# EasyEDA Pro project 立创天空星STM32F407主板.eprj, board PCB1
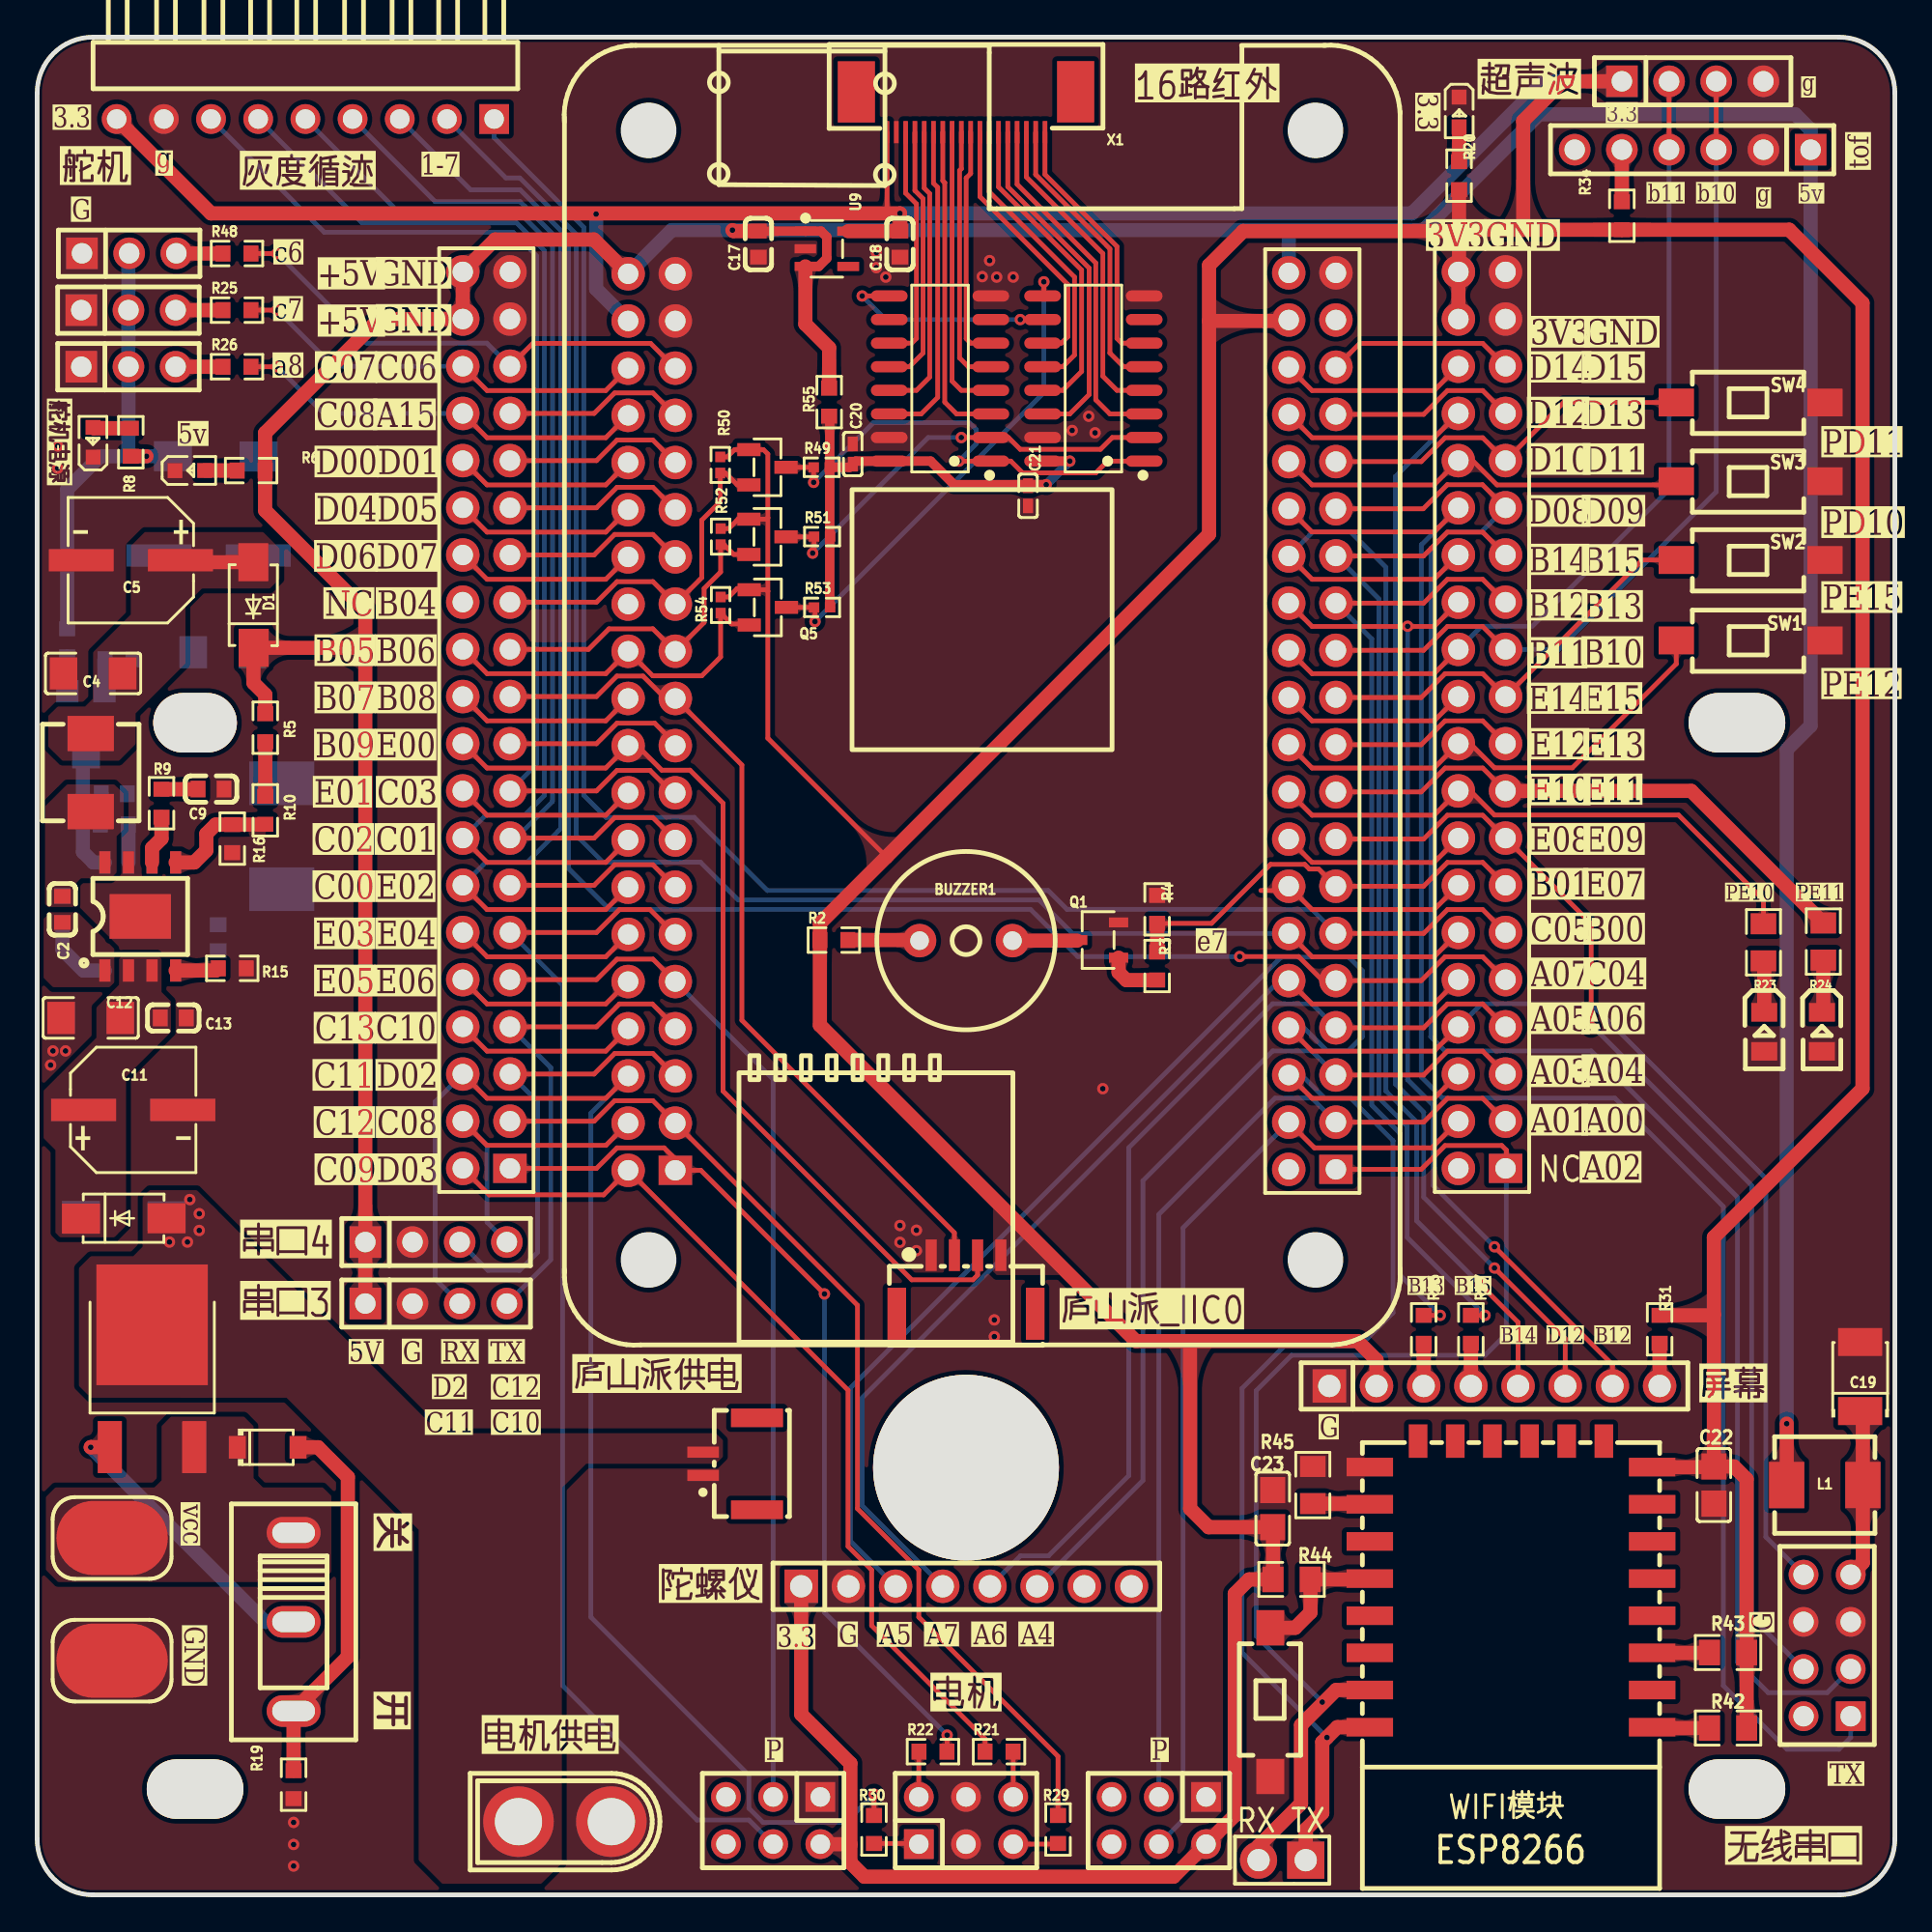
[diagram p4: board, top side]
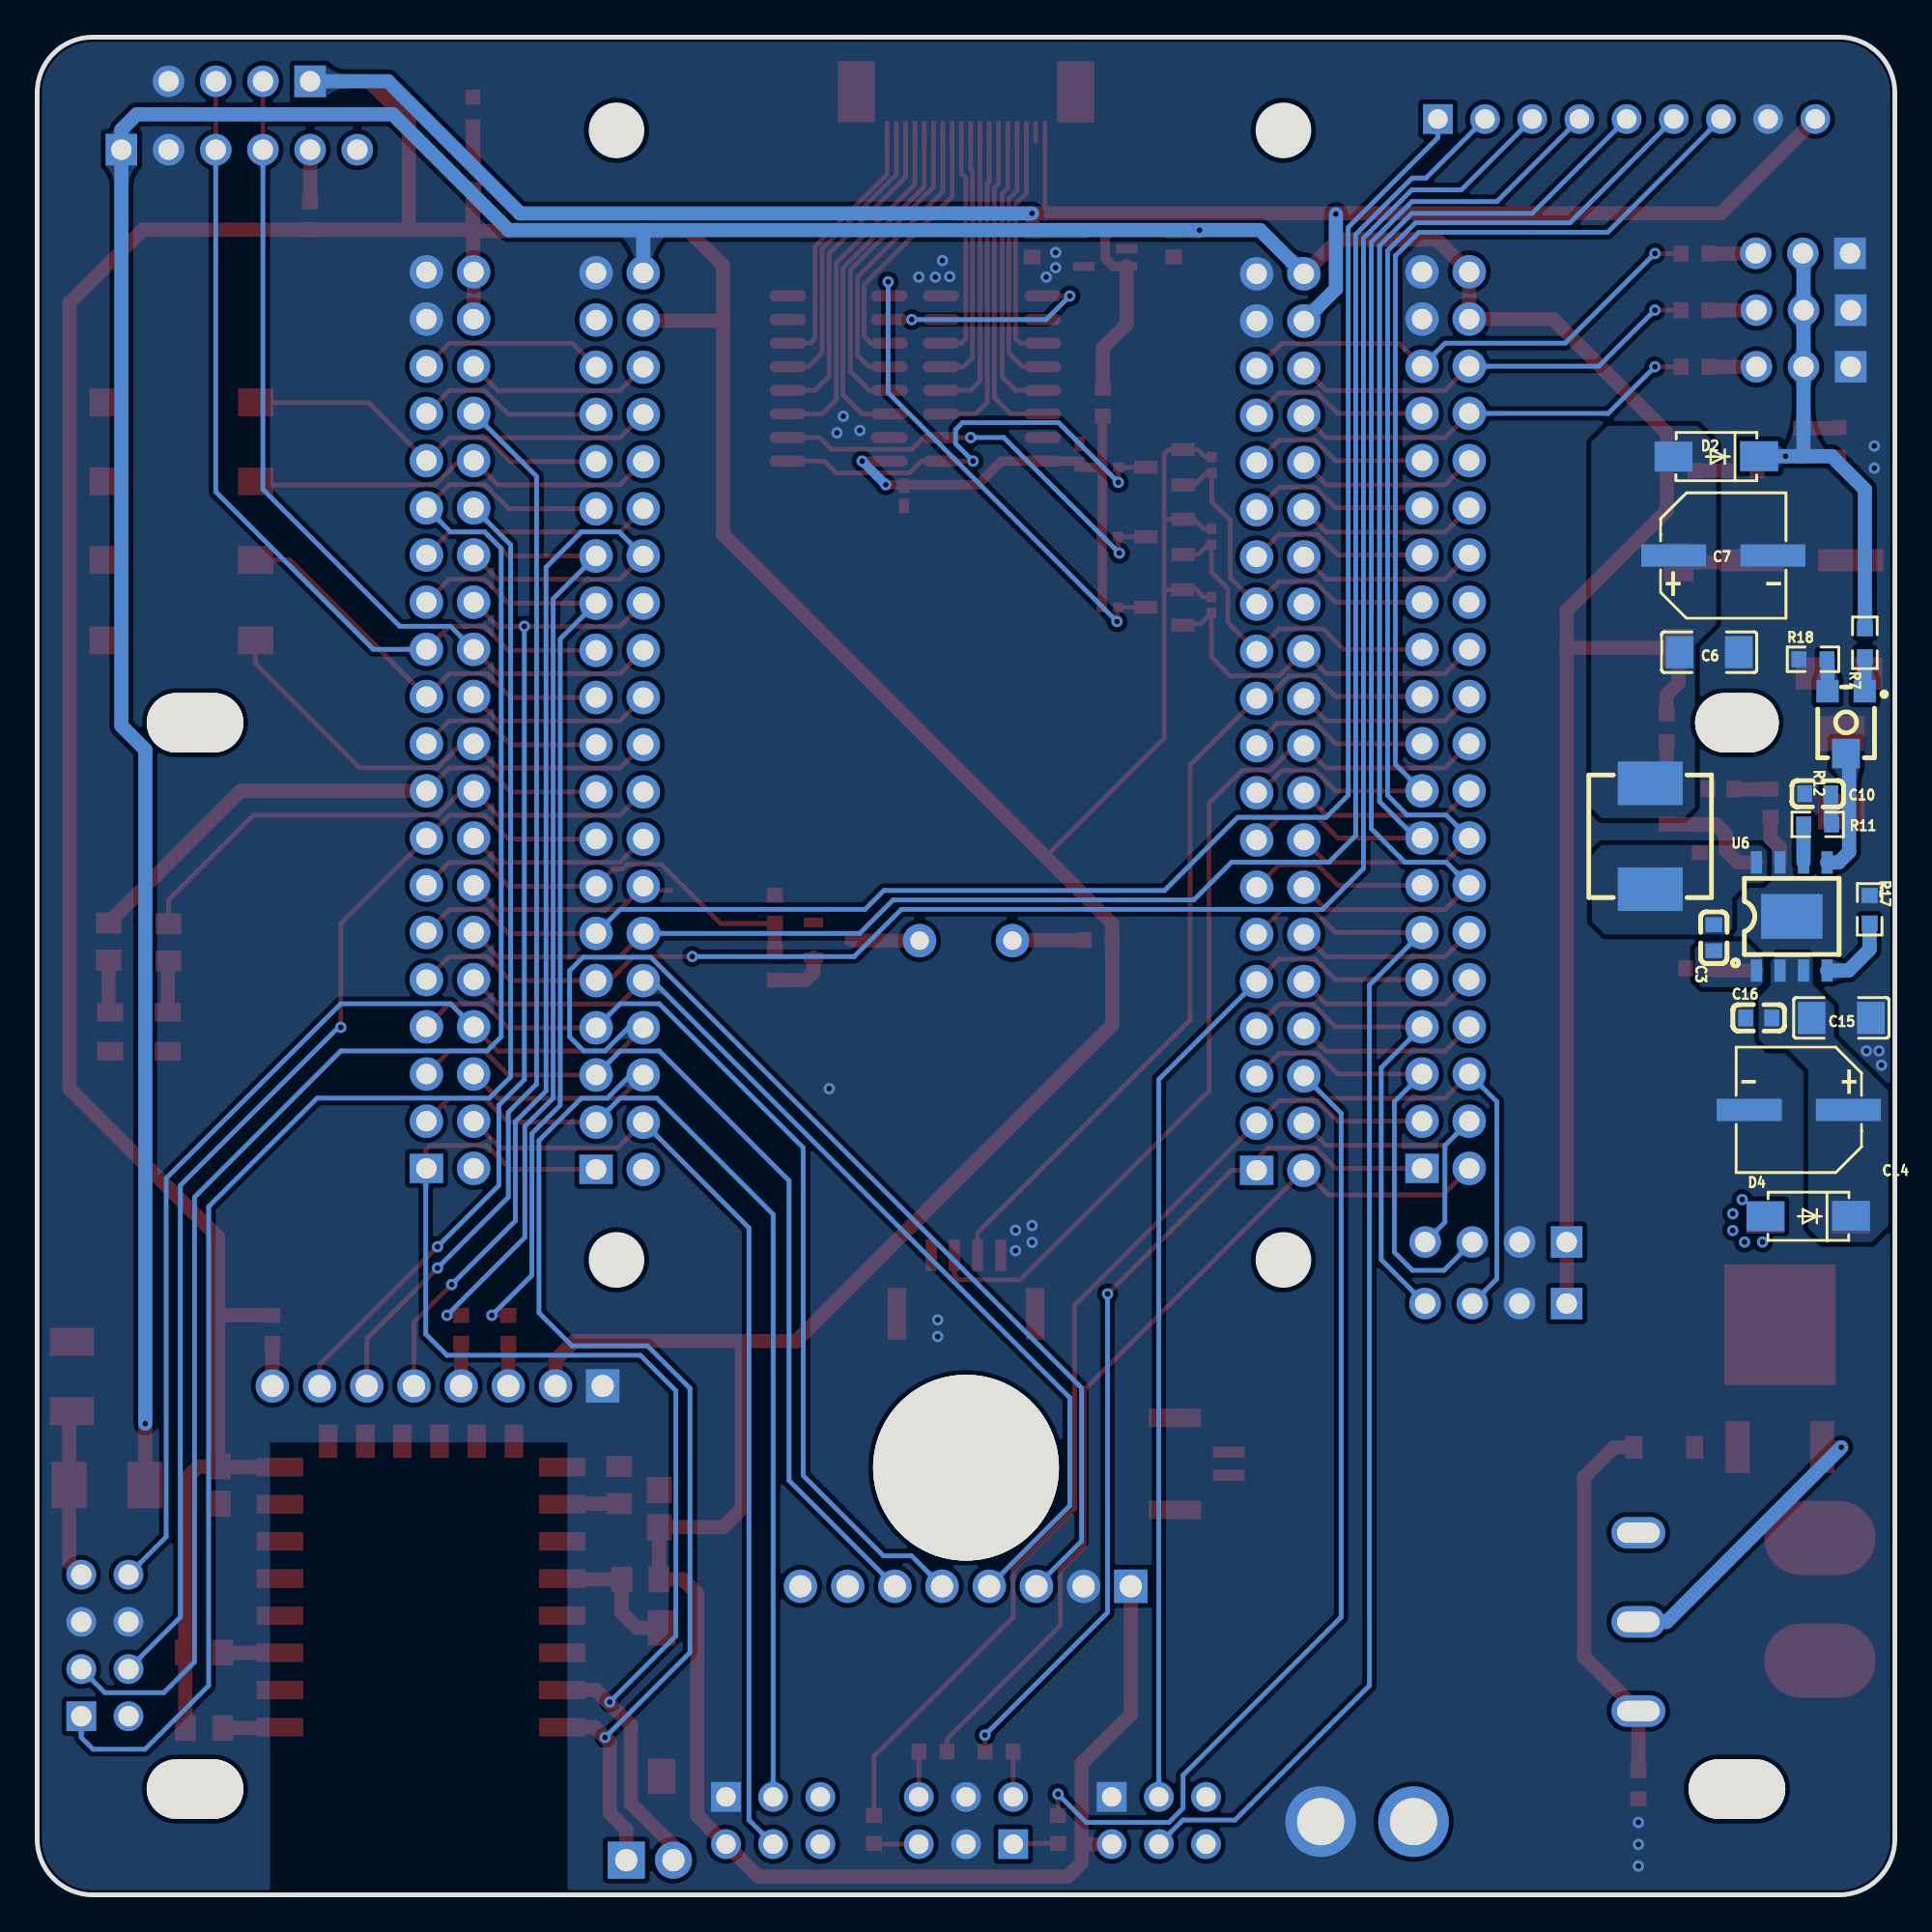
[diagram p5: board, bottom side, seen from below]

Outline 100 x 100 mm; copper layers: Top Layer, Bottom Layer. Coordinates in mm from the lower left corner of the outline.
Outline path: 0,97 arc(0.88,99.12) 3,100 97,100 arc(99.12,99.12) 100,97 100,3 arc(99.12,0.88) 97,0 3,0 arc(0.88,0.88) 0,3 0,97
Stack: Top Layer 0.035mm / Dielectric1 1.51mm FR4 er 4.5 / Bottom Layer 0.035mm

## Design rules (mm)
template: 自用
spacing copperThickness1oz (default): track to track 0.102, other pairs 0.152 to 0.3
spacing copperThickness2oz: track to track 0.203, other pairs 0.152 to 0.3
track width copperThickness1oz (default): min 0.127, default 0.254, max 2.54
track width copperThickness2oz: min 0.203, default 0.254, max 2.54
track width Power_high: min 1.524, default 1.524, max 3.81
track width Power_low: min 0.762, default 0.762, max 2.54
differential pair differentialPair (default): width min 0.127, default 0.254, max 2.54; gap min 0.152, default 0.152
via viaSize (default): diameter min 0.5, default 0.61, max 10; hole min 0.3, default 0.305, max 6.3

## Placement (name value [footprint] x y rotation side)
BUZZER1  3kHz  [BUZ-TH_BD9.6-P5.00-D0.7-FD]  50 51.37 0 top
C2  100nF  [C0603]  1.36 53.05 90 top
C3  100nF  [C0603]  9.74 51.52 90 bottom
C4  47uF  [C1206]  3.01 65.75 0 top
C5  100uF  [CAP-SMD_BD6.3-L6.6-W6.6-LS7.6-FD-1]  5.04 71.84 180 top
C6  47uF  [C1206]  9.99 66.89 0 bottom
C7  100uF  [CAP-SMD_BD6.3-L6.6-W6.6-LS7.6-FD-1]  9.23 72.1 180 bottom
C9  4.7nF  [C0603]  9.36 59.53 0 top
C10  4.7nF  [C0603]  4.15 59.27 0 bottom
C11  100uF  [CAP-SMD_BD6.3-L6.6-W6.6-LS7.6-FD-1]  5.17 42.25 0 top
C12  4.7uF  [C1206]  2.88 47.21 0 top
C13  100nF  [C0603]  7.33 47.21 180 top
C14  100uF  [CAP-SMD_BD6.3-L6.6-W6.6-LS7.6-FD-1]  5.17 42.25 0 bottom
C15  4.7uF  [C1206]  2.88 47.21 0 bottom
C16  100nF  [C0603]  7.33 47.21 180 bottom
C17  10uF  [C0603]  38.82 88.86 90 top
C18  10uF  [C0603]  46.44 88.86 90 top
C19  47uF  [CASE-B_3528]  98.13 27.9 90 top
C20  100nF  [C0402]  43.9 77.56 90 top
C21  100nF  [C0402]  53.34 75.31 270 top
C22  100nF  [C0805]  90.26 22.06 90 top
C23  100nF  [C0805]  66.51 20.79 270 top
CN1  XT30U-M  [CONN-TH_XT30U-M]  28.41 3.94 0 top
CN2  WAFER-GH1.25-2PWB  [CONN-TH_2P-P1.25_XUNPU_WAFER-GH1.25-2PWB]  37.3 23.2 90 top
D1  SS54  [SMA_L4.3-W2.6-LS5.0-FD]  11.65 69.43 270 top
D2  SS54  [SMA_L4.3-W2.6-LS5.0-FD]  9.61 77.43 180 bottom
D3  SS54  [SMA_L4.3-W2.6-LS5.0-FD]  4.66 36.41 180 top
D4  SS54  [SMA_L4.3-W2.6-LS5.0-FD]  4.66 36.54 180 bottom
D5  BZT52C16  [SOD-123_L2.7-W1.6-LS3.7-RD]  12.41 24.09 0 top
EVK2  LCKFB-LSPI-SkyStar-GD32F407VET6-LITE  [DIP-80_L44.97-W69.97-P2.54X2-LS35.9]  50.86 63.16 180 top
H3  -  [HDR-TH_3P-P2.54-V-M]  4.91 85.31 0 top
H4  -  [HDR-TH_3P-P2.54-V-M]  4.91 82.26 0 top
H5  PM254V-12-08-H85  [HDR-TH_8P-P2.54-V-F-R2-C4-S2.54]  96.35 13.42 90 top
H8  2.54-2*3  [HDR-TH_6P-P2.54-V-R2-C3-S2.54_A2541WV-2X3P]  50 4 0 top
H9  2.54-2*3  [HDR-TH_6P-P2.54-V-R2-C3-S2.54_A2541WV-2X3P]  39.62 4 180 top
H10  2.54-2*3  [HDR-TH_6P-P2.54-V-R2-C3-S2.54_A2541WV-2X3P]  60.38 4 180 top
H11  HC-PZ254-13.8L-1x9PWA  [HDR-TH_9P-P2.54-H-M-W10.4-N]  14.44 95.59 180 top
H12  -  [HDR-TH_4P-P2.54-V-F]  89.12 97.62 0 top
H13  PZ254V-11-06P  [HDR-TH_6P-P2.54-V-M]  89.12 93.94 180 top
H14  PZ254V-11-02P  [HDR-TH_2P-P2.54-V-M]  67.02 1.87 180 top
H15  -  [HDR-TH_3P-P2.54-V-M]  4.95 88.37 0 top
H16  KH-2.54PH180-1X4P-L11.5  [HDR-TH_4P-P2.54-V-M]  21.48 31.83 0 top
H17  KH-2.54PH180-1X4P-L11.5  [HDR-TH_4P-P2.54-V-M]  21.48 35.14 0 top
L1  4.7uH  [IND-SMD_L5.4-W5.2_FXL0530]  96.23 22.06 0 top
LED1  NCD0805R1  [LED0805-R-RD]  92.97 46.46 270 top
LED2  19-213/Y2C-CQ2R2L/3T(CY)  [LED0603-RD-YELLOW]  3.01 78.19 90 top
LED3  NCD0805R1  [LED0805-R-RD]  96.08 46.46 270 top
LED6  19-213/Y2C-CQ2R2L/3T(CY)  [LED0603-RD-YELLOW]  8.22 76.67 0 top
LED7  KT-0603R  [LED0603-RD]  76.54 95.97 270 top
NOREF  -  [Pad_e2595]  91.5 5.69 90 top
NOREF#2  -  [Pad_e2594]  91.5 63.09 90 top
NOREF#3  -  [Pad_e2593]  8.5 63.09 90 top
NOREF#4  -  [Pad_e2592]  50 22.99 0 top
NOREF#5  -  [Pad_e2596]  8.5 5.69 90 top
P1  2.54-1*8P母环保  [HDR-TH_8P-P2.54-V-F-1]  78.45 27.39 0 top
P2  2.54-1*8P母环保  [HDR-TH_8P-P2.54-V-F-1]  50.02 16.61 0 top
Q1  S8050 J3Y(RANGE:200-350)  [SOT-23-3_L3.0-W1.7-P0.95-LS2.9-BR]  57.11 51.4 0 top
Q2  HY19P03D  [TO-252-2_L6.6-W6.1-P4.57-LS9.9-TL-CW]  6.19 27.39 90 top
Q3  AO3400A  [SOT-23-3_L2.9-W1.3-P1.90-LS2.4-BR]  39.31 76.85 180 top
Q4  AO3400A  [SOT-23-3_L2.9-W1.3-P1.90-LS2.4-BR]  39.31 73.1 180 top
Q5  AO3400A  [SOT-23-3_L2.9-W1.3-P1.90-LS2.4-BR]  39.33 69.3 180 top
R2  10Ω  [R0603]  42.89 51.4 0 top
R3  4.7kΩ  [R0603]  60.29 50 270 top
R4  4.7kΩ  [R0603]  60.29 53.05 90 top
R5  51kΩ  [R0603]  12.28 62.83 90 top
R6  10k  [R0603]  11.52 76.67 0 top
R7  27k  [R0603]  1.61 67.4 90 bottom
R8  10k  [R0603]  5.04 78.19 270 top
R9  20kΩ  [R0603]  6.69 58.76 270 top
R10  1.5kΩ  [R0603]  12.28 58.38 90 top
R11  20kΩ  [R0603]  4.15 57.62 0 bottom
R12  50K  [RES-ADJ-SMD_3P-L3.8-W3.7_VGF39NCHXT]  2.62 63.11 90 bottom
R15  200kΩ  [R0603]  10.5 49.87 0 top
R16  10kΩ  [R0603]  10.5 56.86 90 top
R17  200kΩ  [R0603]  1.36 53.05 90 bottom
R18  8.2  [R0603]  4.41 66.51 180 bottom
R19  10kΩ  [R0603]  13.8 5.93 90 top
R20  4.7kΩ  [R0603]  76.54 92.55 270 top
R21  100Ω  [R0603]  51.78 7.71 0 top
R22  100Ω  [R0603]  48.22 7.71 0 top
R23  10K  [R0805]  92.93 51.28 90 top
R24  10K  [R0805]  96.15 51.32 90 top
R25  10K  [R0603]  10.76 85.31 0 top
R26  10K  [R0603]  10.76 82.26 0 top
R29  100Ω  [R0603]  54.95 3.52 270 top
R30  100Ω  [R0603]  45.05 3.52 90 top
R31  1KΩ  [R0603]  87.34 30.44 90 top
R34  10K  [R0603]  85.31 90.39 270 top
R42  10K  [R0805]  91.02 8.98 180 top
R43  10K  [R0805]  91.02 13.04 180 top
R44  10K  [R0805]  67.53 16.98 0 top
R45  10K  [R0805]  68.67 22.06 270 top
R46  100Ω  [R0603]  74.64 30.44 270 top
R47  100Ω  [R0603]  77.18 30.44 270 top
R48  10K  [R0603]  10.76 88.35 0 top
R49  10K  [R0402]  42.23 76.85 0 top
R50  4.7K  [R0402]  36.77 76.97 90 top
R51  10K  [R0402]  42.25 73.11 0 top
R52  4.7K  [R0402]  36.79 73.11 90 top
R53  10K  [R0402]  42.25 69.3 0 top
R54  4.7K  [R0402]  36.79 69.43 90 top
R55  10K  [R0603]  42.63 80.35 90 top
SW1  TS-1101-C-W  [SW-SMD_L6.0-W3.3-LS8.0]  92.24 67.53 0 top
SW2  TS-1101-C-W  [SW-SMD_L6.0-W3.3-LS8.0]  92.24 71.85 0 top
SW3  TS-1101-C-W  [SW-SMD_L6.0-W3.3-LS8.0]  92.24 76.09 0 top
SW4  TS-1101-C-W  [SW-SMD_L6.0-W3.3-LS8.0]  92.24 80.33 0 top
SW6  TS-1101-C-W  [SW-SMD_L6.0-W3.3-LS8.0]  66.38 10.38 270 top
SW7  SS12D10G6  [SW-TH_SHOU-HAN_SS12D10G4]  13.8 14.69 270 top
U1  GPHA201-2002A001A1BA  [HDR-TH_40P-P2.54-V-M-R2-C20-S2.54]  77.78 63.23 90 top
U2  GPHA201-2002A001A1BA  [HDR-TH_40P-P2.54-V-M-R2-C20-S2.54]  24.18 63.23 90 top
U3  4.7uH  [IND-SMD_L5.2-W5.2_MCW-0530]  2.88 60.41 90 top
U4  4.7uH  [IND-SMD_L7.2-W6.6_GPSR07X0]  13.17 56.98 90 bottom
U5  SCT2450STER  [ESOP-8_L4.9-W3.9-P1.27-LS6.0-BL-EP]  5.55 52.67 0 top
U6  SCT2450STER  [ESOP-8_L4.9-W3.9-P1.27-LS6.0-BL-EP]  5.55 52.67 180 bottom
U7  -  [WIREPAD-4X6]  4.03 19.21 0 top
U8  -  [WIREPAD-4X6]  4.03 12.61 0 top
U9  RT9013-33GB  [SOT-23-5_L3.0-W1.7-P0.95-LS2.8-BL]  42.51 88.61 270 top
U10  SN74LS165ADR  [SOIC-16_L9.9-W3.9-P1.27-LS6.0-BL]  56.86 81.62 90 top
U11  SN74LS165ADR  [SOIC-16_L9.9-W3.9-P1.27-LS6.0-BL]  48.6 81.62 90 top
U12  WAFER-GH1.25-4PWB  [CONN-SMD_4P-P1.25_XUNPU_WAFER-GH1.25-4PWB]  50 32.86 0 top
U13  WT8266-S5 ESP-12F  [WIRELM-SMD_WT8266-S5-ESP-12F]  79.34 16.73 180 top
X1  AFC07-S18FCA-00  [FPC-SMD_AFC07-S18FCA-00]  50 95.97 180 top

## Footprints (pads in the part's own frame, mm; a bottom-side part is the same pattern mirrored in y, then rotated)
BUZ-TH_BD9.6-P5.00-D0.7-FD
  round 1.8 hole 1: 1(-2.5,0) 2(2.5,0)
C0402
  rect 0.79x0.54 smd: 1(-0.545,0) 2(0.545,0)
C0603
  rect 0.8x0.9 smd: 1(-0.7,0) 2(0.7,0)
C0805
  rect 1.41x1.35 smd: 1(-1,0) 2(1,0)
C1206
  rect 1.485x1.728 smd: 1(-1.593,0) 2(1.593,0)
CAP-SMD_BD6.3-L6.6-W6.6-LS7.6-FD-1
  rect 3.5x1.2 smd: 1(-2.67,0) 2(2.67,0)
CASE-B_3528
  rect 1.506x2.376 smd: 1(-1.861,0) 2(1.861,0)
CONN-SMD_4P-P1.25_XUNPU_WAFER-GH1.25-4PWB
  rect 0.6x1.7 smd: 1(-1.875,1.575) 2(-0.625,1.575) 3(0.625,1.575) 4(1.875,1.575)
  rect 1x2.8 smd: 5(3.725,-1.575) 6(-3.725,-1.575)
CONN-TH_2P-P1.25_XUNPU_WAFER-GH1.25-2PWB
  rect 0.6x1.7 smd: 1(-0.625,1.45) 2(0.625,1.45)
  rect 1x2.8 smd: 3(-2.475,-1.45) 4(2.475,-1.45)
CONN-TH_XT30U-M
  round 3.8 hole 2.54: 1(-2.5,0) 2(2.5,0)
DIP-80_L44.97-W69.97-P2.54X2-LS35.9
  rect 1.8x1.575 hole 1.1: 1(-19.05,24.105) 41(16.51,24.155)
  round 1.8 hole 1.1: 2(-16.51,24.105) 3(-19.05,21.564) 4(-16.51,21.564) 5(-19.05,19.024) 6(-16.51,19.024) 7(-19.05,16.485) 8(-16.51,16.485) 9(-19.05,13.944) 10(-16.51,13.944) 11(-19.05,11.405) 12(-16.51,11.405) 13(-19.05,8.864) 14(-16.51,8.864) 15(-19.05,6.324) 16(-16.51,6.324) 17(-19.05,3.784) 18(-16.51,3.784) 19(-19.05,1.244) 20(-16.51,1.244) 21(-19.05,-1.296) 22(-16.51,-1.296) 23(-19.05,-3.836) 24(-16.51,-3.836) 25(-19.05,-6.375) 26(-16.51,-6.375) 27(-19.05,-8.915) 28(-16.51,-8.915) 29(-19.05,-11.456) 30(-16.51,-11.456) 31(-19.05,-13.995) 32(-16.51,-13.995) 33(-19.05,-16.535) 34(-16.51,-16.535) 35(-19.05,-19.076) 36(-16.51,-19.076) 37(-19.05,-21.616) 38(-16.51,-21.616) 39(-19.05,-24.155) 40(-16.51,-24.155) 42(19.05,24.155) 43(16.51,21.616) 44(19.05,21.616) 45(16.51,19.076) 46(19.05,19.076) 47(16.51,16.535) 48(19.05,16.535) 49(16.51,13.995) 50(19.05,13.995) 51(16.51,11.456) 52(19.05,11.456) 53(16.51,8.915) 54(19.05,8.915) 55(16.51,6.375) 56(19.05,6.375) 57(16.51,3.836) 58(19.05,3.836) 59(16.51,1.296) 60(19.05,1.296) 61(16.51,-1.244) 62(19.05,-1.244) 63(16.51,-3.784) 64(19.05,-3.784) 65(16.51,-6.324) 66(19.05,-6.324) 67(16.51,-8.864) 68(19.05,-8.864) 69(16.51,-11.405) 70(19.05,-11.405) 71(16.51,-13.944) 72(19.05,-13.944) 73(16.51,-16.485) 74(19.05,-16.485) 75(16.51,-19.024) 76(19.05,-19.024) 77(16.51,-21.564) 78(19.05,-21.564) 79(16.51,-24.105) 80(19.05,-24.105)
ESOP-8_L4.9-W3.9-P1.27-LS6.0-BL-EP
  rect 0.6x1.2 smd: 1(-1.905,-2.909) 2(-0.635,-2.909) 3(0.635,-2.909) 4(1.905,-2.909) 5(1.905,2.909) 6(0.635,2.909) 7(-0.635,2.909) 8(-1.905,2.909)
  rect 3.3x2.4 smd: 9(0,0)
FPC-SMD_AFC07-S18FCA-00
  rect 0.25x1.2 smd: 1(-4.25,1.089) 2(-3.75,1.089) 3(-3.25,1.089) 4(-2.75,1.089) 5(-2.25,1.089) 6(-1.75,1.089) 7(-1.25,1.089) 8(-0.75,1.089) 9(-0.25,1.089) 10(0.25,1.089) 11(0.75,1.089) 12(1.25,1.089) 13(1.75,1.089) 14(2.25,1.089) 15(2.75,1.089) 16(3.25,1.089) 17(3.75,1.089) 18(4.25,1.089)
  rect 2x3.3 smd: 19(5.901,-1.081) 20(-5.901,-1.089)
HDR-TH_2P-P2.54-V-M
  rect 2x2 hole 1.2: 1(-1.27,0)
  round 2 hole 1.2: 2(1.27,0)
HDR-TH_3P-P2.54-V-M
  rect 1.7x1.7 hole 1.1: 1(-2.54,0)
  round 1.7 hole 1.1: 2(0,0) 3(2.54,0)
HDR-TH_4P-P2.54-V-F
  rect 1.7x1.7 hole 1.1: 1(-3.81,0)
  round 1.7 hole 1.1: 2(-1.27,0) 3(1.27,0) 4(3.81,0)
HDR-TH_4P-P2.54-V-M
  rect 1.7x1.7 hole 1.1: 1(-3.81,0)
  round 1.7 hole 1.1: 2(-1.27,0) 3(1.27,0) 4(3.81,0)
HDR-TH_6P-P2.54-V-M
  rect 1.7x1.7 hole 1.1: 1(-6.35,0)
  round 1.7 hole 1.1: 2(-3.81,0) 3(-1.27,0) 4(1.27,0) 5(3.81,0) 6(6.35,0)
HDR-TH_6P-P2.54-V-R2-C3-S2.54_A2541WV-2X3P
  rect 1.6x1.6 hole 1.05: 1(-2.54,-1.27)
  round 1.6 hole 1.05: 2(-2.54,1.27) 3(0,-1.27) 4(0,1.27) 5(2.54,-1.27) 6(2.54,1.27)
HDR-TH_8P-P2.54-V-F-1
  rect 1.8x1.8 hole 1.2: 1(-8.89,0)
  round 1.8 hole 1.2: 2(-6.35,0) 3(-3.81,0) 4(-1.27,0) 5(1.27,0) 6(3.81,0) 7(6.35,0) 8(8.89,0)
HDR-TH_8P-P2.54-V-F-R2-C4-S2.54
  rect 1.6x1.6 hole 1.1: 1(-3.81,-1.27)
  round 1.6 hole 1.1: 2(-3.81,1.27) 3(-1.27,-1.27) 4(-1.27,1.27) 5(1.27,-1.27) 6(1.27,1.27) 7(3.81,-1.27) 8(3.81,1.27)
HDR-TH_9P-P2.54-H-M-W10.4-N
  rect 1.6x1.6 hole 1.05: 1(-10.16,0)
  round 1.6 hole 1.05: 2(-7.62,0) 3(-5.08,0) 4(-2.54,0) 5(0,0) 6(2.54,0) 7(5.08,0) 8(7.62,0) 9(10.16,0)